# Altium schematic sheet VME.SCHDOC: FPGA Rack
size 420 x 297 mm; DrawnBy: zas; Revision: V1.0; SheetNumber: 10; SheetTotal: 25; DocumentName: VME.SCHDOC
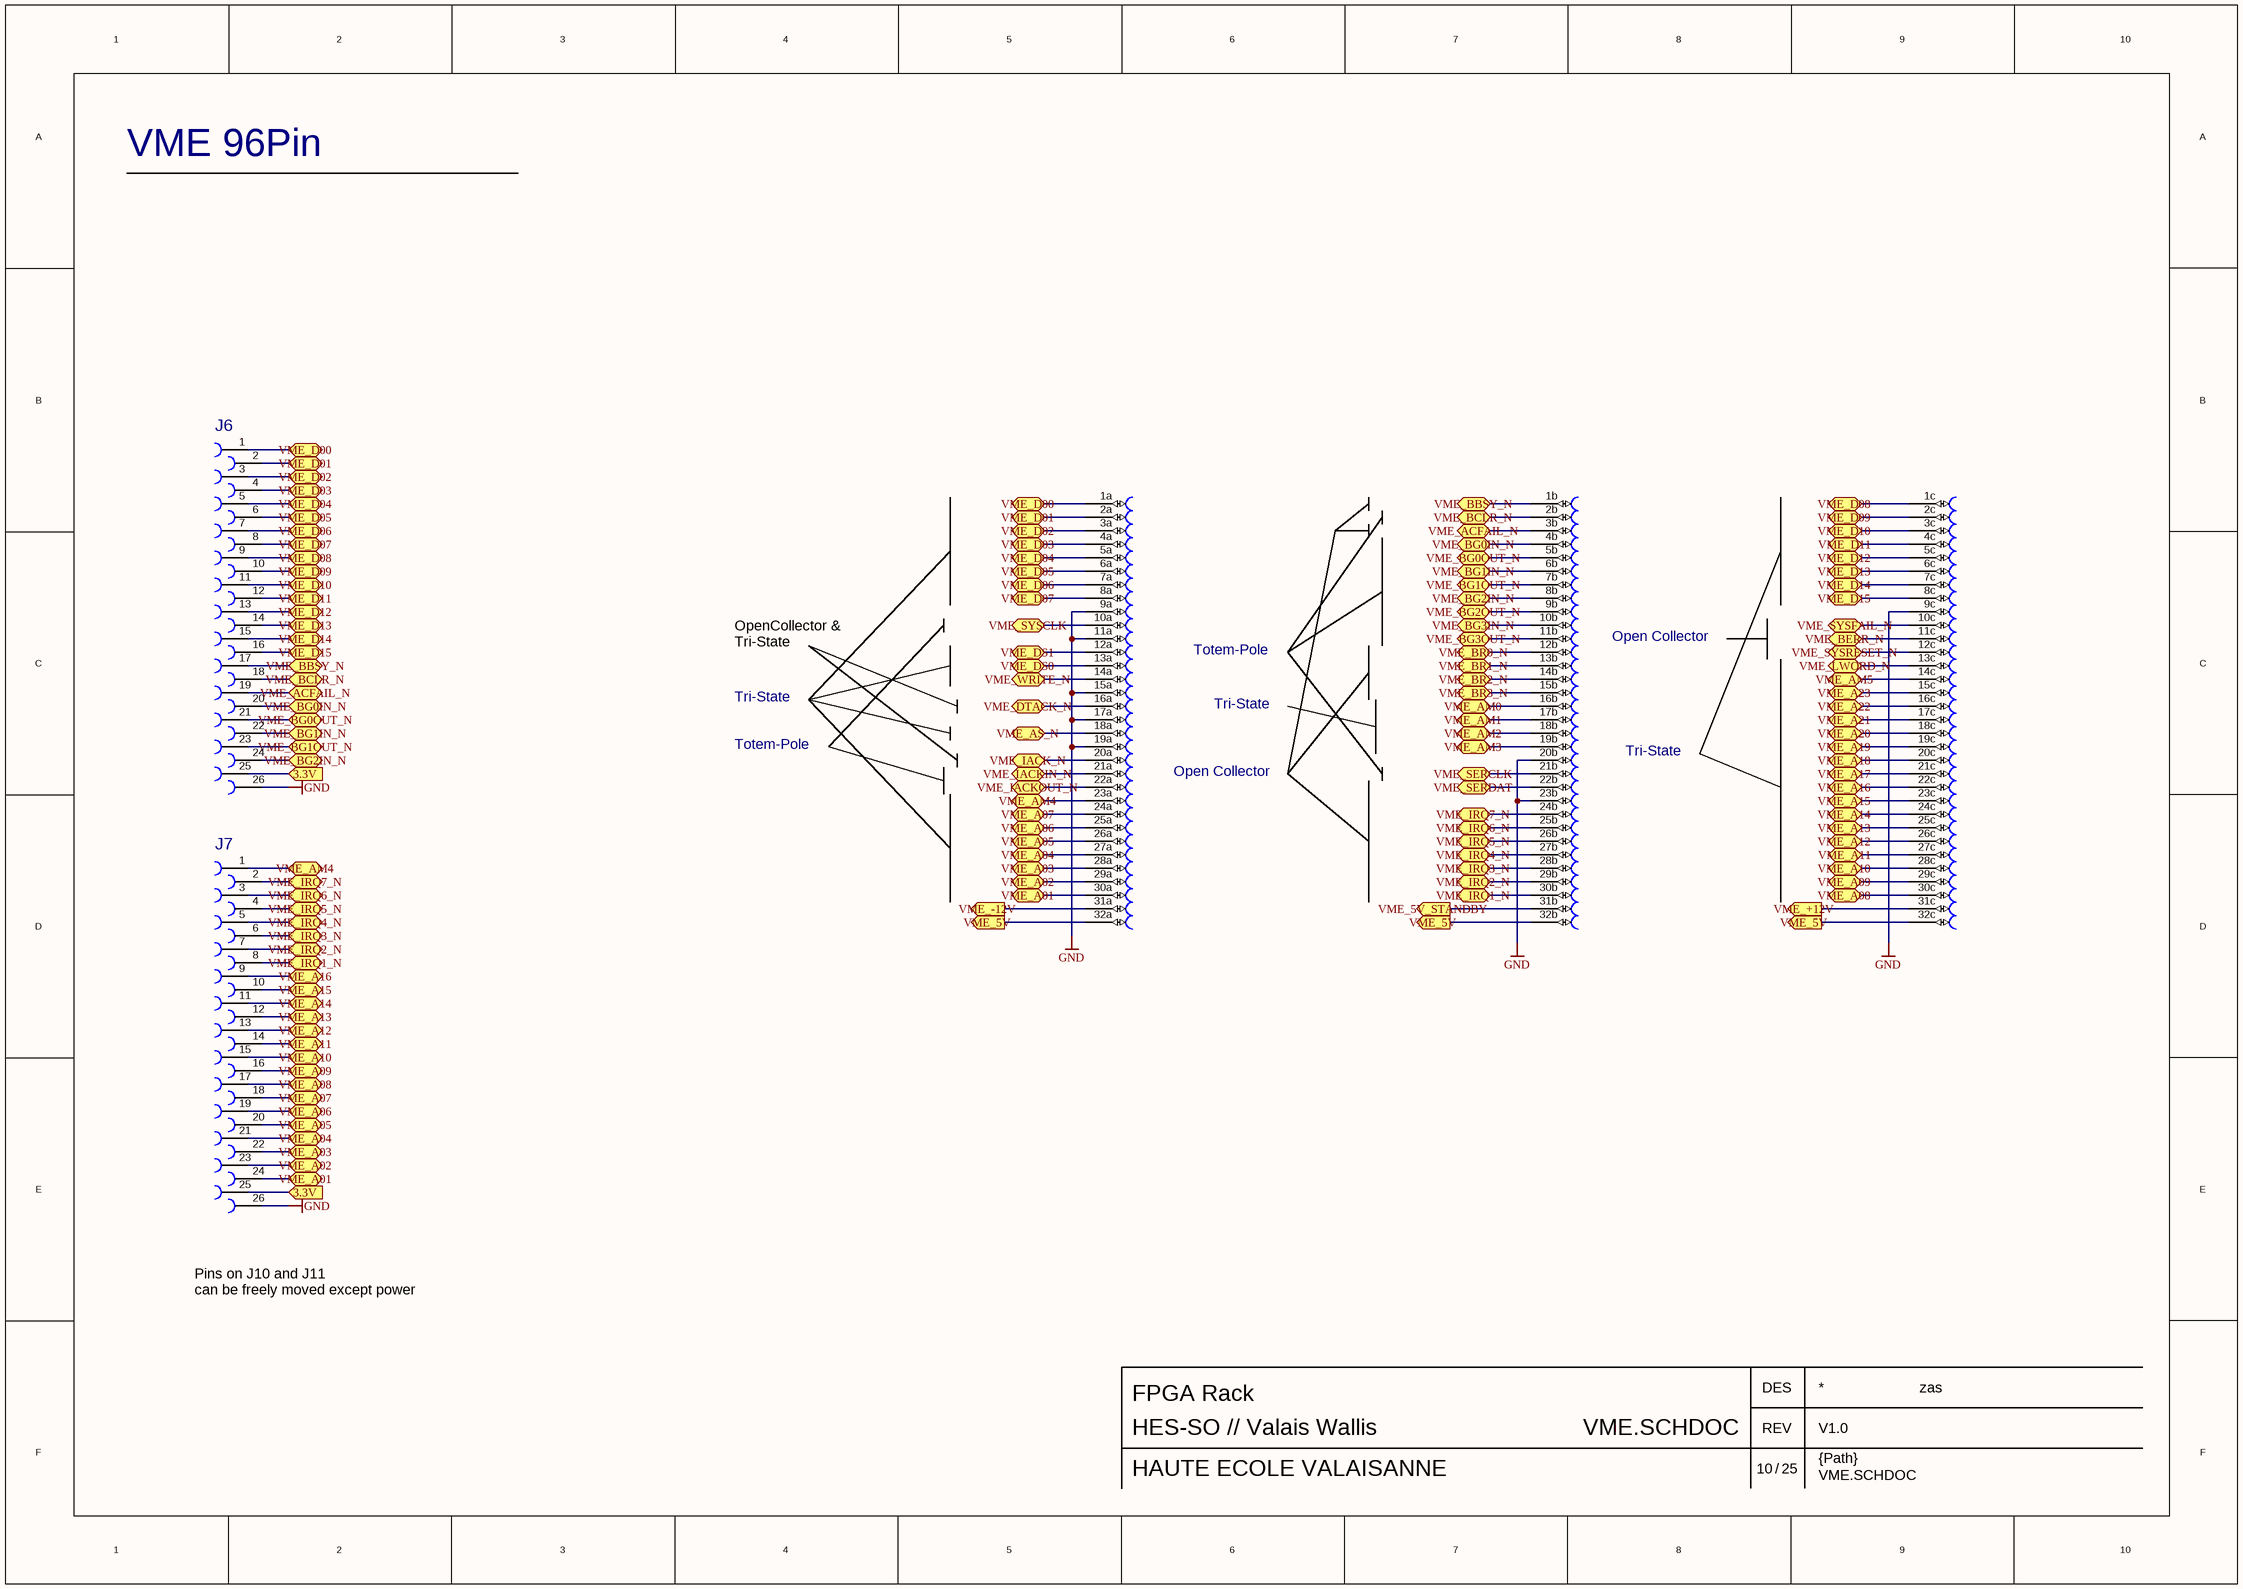
[diagram p0: VME.SCHDOC]

## Parts
J6  ASSM-AWHW2-26G  [ASSM-AWHW2-26G]  (value not drawn)
J7  ASSM-AWHW2-26G  [ASSM-AWHW2-26G]  (value not drawn)
J8  DIN41612-3X32FC  [CONN3X32]  (value not drawn)  (parts A,B,C,D,E,F,G,H,I,J,K,L,M,N,O,P,Q,R,S,T,U,V,W,X,Y,Z,27,28,29,30,31,32,33,34,35,36,37,38,39,40,41,42,43,44,45,46,47,48,49,50,51,52,53,54,55,56,57,58,59,60,61,62,63,64,65,66,67,68,69,70,71,72,73,74,75,76,77,78,79,80,81,82,83,84,85,86,87,88,89,90,91,92,93,94,95,96 of 96)

## Ports
3.3V (in), VME_5V (out), VME_5V_STANDBY (out), VME_+12V (out), VME_-12V (out), VME_A01 (bidir), VME_A02 (bidir), VME_A03 (bidir), VME_A04 (bidir), VME_A05 (bidir), VME_A06 (bidir), VME_A07 (bidir), VME_A08 (bidir), VME_A09 (bidir), VME_A10 (bidir), VME_A11 (bidir), VME_A12 (bidir), VME_A13 (bidir), VME_A14 (bidir), VME_A15 (bidir), VME_A16 (bidir), VME_A17 (bidir), VME_A18 (bidir), VME_A19 (bidir), VME_A20 (bidir), VME_A21 (bidir), VME_A22 (bidir), VME_A23 (bidir), VME_ACFAIL_N (bidir), VME_AM0 (bidir), VME_AM1 (bidir), VME_AM2 (bidir), VME_AM3 (bidir), VME_AM4 (bidir), VME_AM5 (bidir), VME_AS_N (bidir), VME_BBSY_N (bidir), VME_BCLR_N (bidir), VME_BERR_N (bidir), VME_BG0IN_N (bidir), VME_BG0OUT_N (bidir), VME_BG1IN_N (bidir), VME_BG1OUT_N (bidir), VME_BG2IN_N (bidir), VME_BG2OUT_N (bidir), VME_BG3IN_N (bidir), VME_BG3OUT_N (bidir), VME_BR0_N (bidir), VME_BR1_N (bidir), VME_BR2_N (bidir), VME_BR3_N (bidir), VME_D00 (bidir), VME_D01 (bidir), VME_D02 (bidir), VME_D03 (bidir), VME_D04 (bidir), VME_D05 (bidir), VME_D06 (bidir), VME_D07 (bidir), VME_D08 (bidir), VME_D09 (bidir), VME_D10 (bidir), VME_D11 (bidir), VME_D12 (bidir), VME_D13 (bidir), VME_D14 (bidir), VME_D15 (bidir), VME_DS0 (bidir), VME_DS1 (bidir), VME_DTACK_N (bidir), VME_IACK_N (bidir), VME_IACKIN_N (bidir), VME_IACKOUT_N (bidir), VME_IRQ1_N (bidir), VME_IRQ2_N (bidir), VME_IRQ3_N (bidir), VME_IRQ4_N (bidir), VME_IRQ5_N (bidir), VME_IRQ6_N (bidir), VME_IRQ7_N (bidir), VME_LWORD_N (bidir), VME_SERCLK (bidir), VME_SERDAT (bidir), VME_SYSCLK (bidir), VME_SYSFAIL_N (bidir), VME_SYSRESET_N (bidir), VME_WRITE_N (bidir)

## Nets
GND: J6.26 J7.26 J8.9a J8.9c J8.11a J8.15a J8.17a J8.19a J8.20b J8.23b
3.3V: J6.25 J7.25 ; port 3.3V
VME_5V: J8.32a J8.32b J8.32c ; port VME_5V
VME_5V_STANDBY: J8.31b ; port VME_5V_STANDBY
VME_+12V: J8.31c ; port VME_+12V
VME_-12V: J8.31a ; port VME_-12V
VME_A01: J7.24 J8.30a ; port VME_A01
VME_A02: J7.23 J8.29a ; port VME_A02
VME_A03: J7.22 J8.28a ; port VME_A03
VME_A04: J7.21 J8.27a ; port VME_A04
VME_A05: J7.20 J8.26a ; port VME_A05
VME_A06: J7.19 J8.25a ; port VME_A06
VME_A07: J7.18 J8.24a ; port VME_A07
VME_A08: J7.17 J8.30c ; port VME_A08
VME_A09: J7.16 J8.29c ; port VME_A09
VME_A10: J7.15 J8.28c ; port VME_A10
VME_A11: J7.14 J8.27c ; port VME_A11
VME_A12: J7.13 J8.26c ; port VME_A12
VME_A13: J7.12 J8.25c ; port VME_A13
VME_A14: J7.11 J8.24c ; port VME_A14
VME_A15: J7.10 J8.23c ; port VME_A15
VME_A16: J7.9 J8.22c ; port VME_A16
VME_A17: J8.21c ; port VME_A17
VME_A18: J8.20c ; port VME_A18
VME_A19: J8.19c ; port VME_A19
VME_A20: J8.18c ; port VME_A20
VME_A21: J8.17c ; port VME_A21
VME_A22: J8.16c ; port VME_A22
VME_A23: J8.15c ; port VME_A23
VME_ACFAIL_N: J6.19 J8.3b ; port VME_ACFAIL_N
VME_AM0: J8.16b ; port VME_AM0
VME_AM1: J8.17b ; port VME_AM1
VME_AM2: J8.18b ; port VME_AM2
VME_AM3: J8.19b ; port VME_AM3
VME_AM4: J7.1 J8.23a ; port VME_AM4
VME_AM5: J8.14c ; port VME_AM5
VME_AS_N: J8.18a ; port VME_AS_N
VME_BBSY_N: J6.17 J8.1b ; port VME_BBSY_N
VME_BCLR_N: J6.18 J8.2b ; port VME_BCLR_N
VME_BERR_N: J8.11c ; port VME_BERR_N
VME_BG0IN_N: J6.20 J8.4b ; port VME_BG0IN_N
VME_BG0OUT_N: J6.21 J8.5b ; port VME_BG0OUT_N
VME_BG1IN_N: J6.22 J8.6b ; port VME_BG1IN_N
VME_BG1OUT_N: J6.23 J8.7b ; port VME_BG1OUT_N
VME_BG2IN_N: J6.24 J8.8b ; port VME_BG2IN_N
VME_BG2OUT_N: J8.9b ; port VME_BG2OUT_N
VME_BG3IN_N: J8.10b ; port VME_BG3IN_N
VME_BG3OUT_N: J8.11b ; port VME_BG3OUT_N
VME_BR0_N: J8.12b ; port VME_BR0_N
VME_BR1_N: J8.13b ; port VME_BR1_N
VME_BR2_N: J8.14b ; port VME_BR2_N
VME_BR3_N: J8.15b ; port VME_BR3_N
VME_D00: J6.1 J8.1a ; port VME_D00
VME_D01: J6.2 J8.2a ; port VME_D01
VME_D02: J6.3 J8.3a ; port VME_D02
VME_D03: J6.4 J8.4a ; port VME_D03
VME_D04: J6.5 J8.5a ; port VME_D04
VME_D05: J6.6 J8.6a ; port VME_D05
VME_D06: J6.7 J8.7a ; port VME_D06
VME_D07: J6.8 J8.8a ; port VME_D07
VME_D08: J6.9 J8.1c ; port VME_D08
VME_D09: J6.10 J8.2c ; port VME_D09
VME_D10: J6.11 J8.3c ; port VME_D10
VME_D11: J6.12 J8.4c ; port VME_D11
VME_D12: J6.13 J8.5c ; port VME_D12
VME_D13: J6.14 J8.6c ; port VME_D13
VME_D14: J6.15 J8.7c ; port VME_D14
VME_D15: J6.16 J8.8c ; port VME_D15
VME_DS0: J8.13a ; port VME_DS0
VME_DS1: J8.12a ; port VME_DS1
VME_DTACK_N: J8.16a ; port VME_DTACK_N
VME_IACK_N: J8.20a ; port VME_IACK_N
VME_IACKIN_N: J8.21a ; port VME_IACKIN_N
VME_IACKOUT_N: J8.22a ; port VME_IACKOUT_N
VME_IRQ1_N: J7.8 J8.30b ; port VME_IRQ1_N
VME_IRQ2_N: J7.7 J8.29b ; port VME_IRQ2_N
VME_IRQ3_N: J7.6 J8.28b ; port VME_IRQ3_N
VME_IRQ4_N: J7.5 J8.27b ; port VME_IRQ4_N
VME_IRQ5_N: J7.4 J8.26b ; port VME_IRQ5_N
VME_IRQ6_N: J7.3 J8.25b ; port VME_IRQ6_N
VME_IRQ7_N: J7.2 J8.24b ; port VME_IRQ7_N
VME_LWORD_N: J8.13c ; port VME_LWORD_N
VME_SERCLK: J8.21b ; port VME_SERCLK
VME_SERDAT: J8.22b ; port VME_SERDAT
VME_SYSCLK: J8.10a ; port VME_SYSCLK
VME_SYSFAIL_N: J8.10c ; port VME_SYSFAIL_N
VME_SYSRESET_N: J8.12c ; port VME_SYSRESET_N
VME_WRITE_N: J8.14a ; port VME_WRITE_N

## Notes on the sheet
- VME 96Pin
- OpenCollector &
  Tri-State
- Totem-Pole
- (near J8) Open Collector
- Tri-State
- Pins on J10 and J11
  can be freely moved except power
- DES
- HES-SO // Valais Wallis
- HAUTE ECOLE VALAISANNE
- /
- REV
- {Path}

## Library data of the parts
J8 = DIN41612-3X32FC: Value: *